# EasyEDA Pro project 2-64 M circuit board.eprj

# Schematic FUJICA AX-5
Board Name: FUJICA AX-5; Create Date: 2026-02-07; Page Name: 2-64 M circuit board; Project Name: FUJICA AX-5; Schematic Name: FUJICA AX-5; Update Date: 2026-02-09; Company: EasyEDA.com; Page Size: A4; Version: V1.0
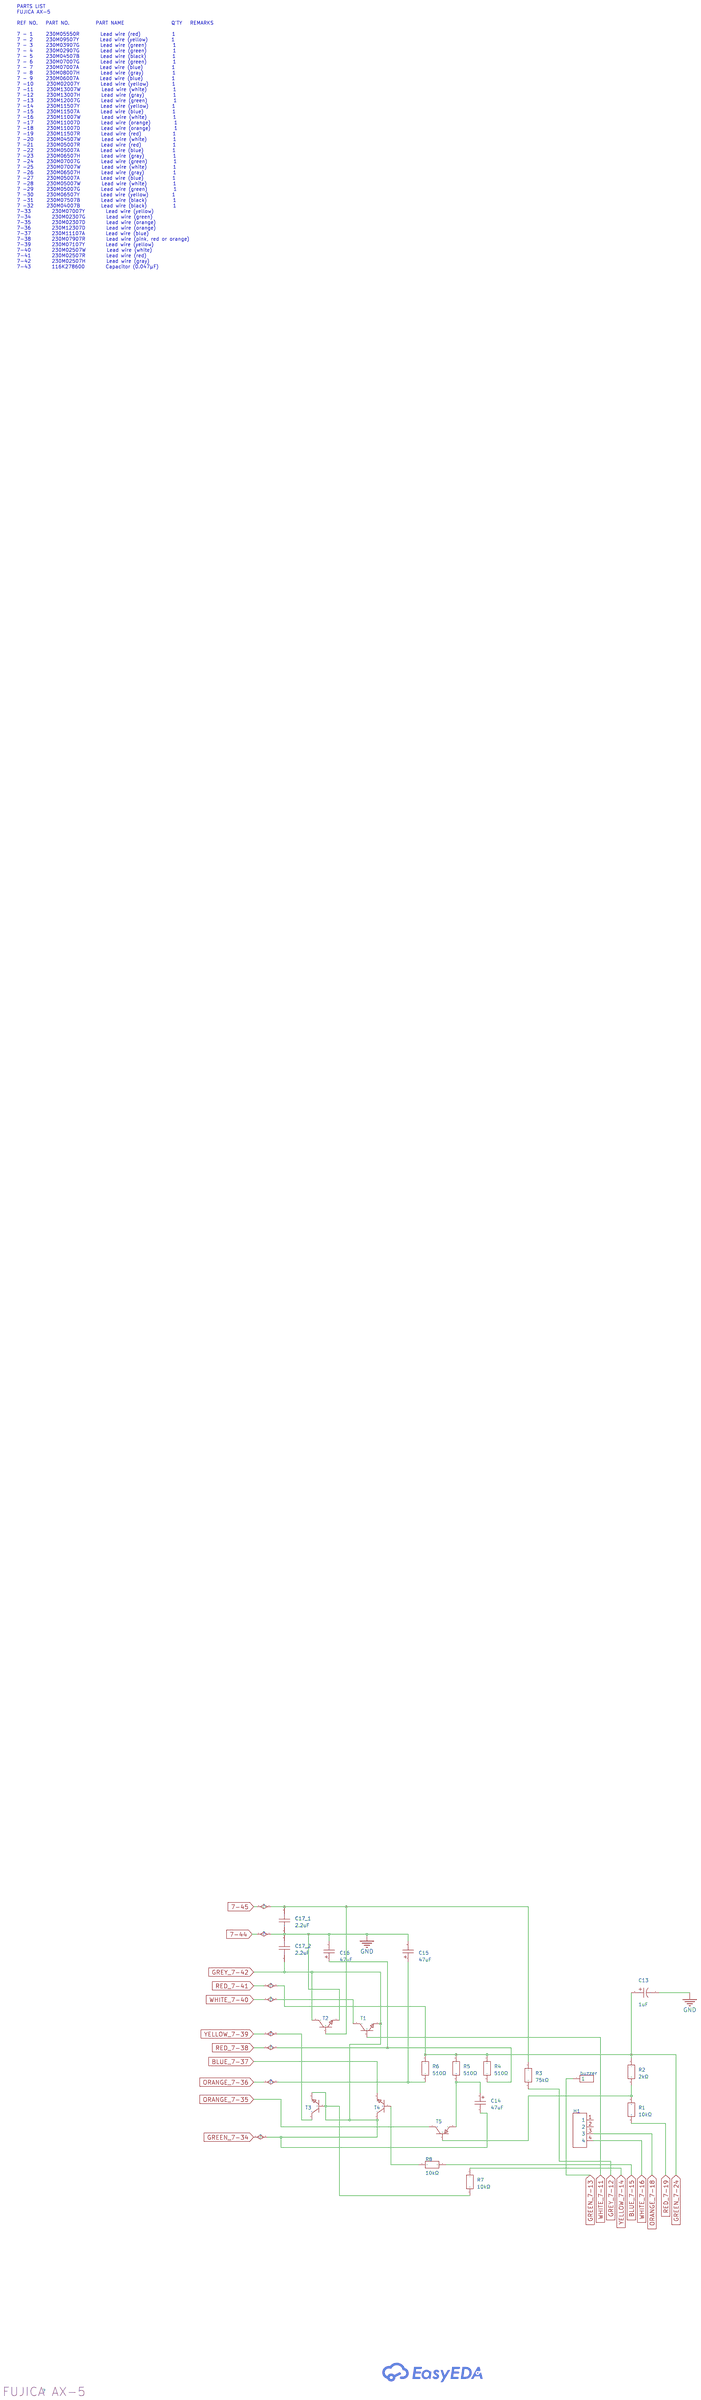
[diagram p0: schematic sheet]

## Parts
buzzer  -  [HDR-TH_1P-V-M_XKB_X4611WV-01I-C28D40]
C13  1uF  [CAP-TH_BD4.5-P2.50-D1.0-FD]
C14  47uF  [CAP-TH_BD5.0-P2.5-D0.5-FD]
C15  47uF  [CAP-TH_BD5.0-P2.5-D0.5-FD]
C16  47uF  [CAP-TH_BD5.0-P2.5-D0.5-FD]
C17_1  2.2uF  [CAP-TH_BD4.5-P2.50-D1.0-FD]
C17_2  2.2uF  [CAP-TH_BD4.5-P2.50-D1.0-FD]
H1  -  [HDR-TH_4P-P2.54-V-M]
R1  510Ω  [RES-TH_BD1.9-L3.3-P7.30-D0.5]
R2  510Ω  [RES-TH_BD1.9-L3.3-P7.30-D0.5]
R3  510Ω  [RES-TH_BD1.9-L3.3-P7.30-D0.5]
R4  510Ω  [RES-TH_BD1.9-L3.3-P7.30-D0.5]
R5  510Ω  [RES-TH_BD1.9-L3.3-P7.30-D0.5]
R6  510Ω  [RES-TH_BD1.9-L3.3-P7.30-D0.5]
R7  510Ω  [RES-TH_BD1.9-L3.3-P7.30-D0.5]
R8  510Ω  [RES-TH_BD1.9-L3.3-P7.30-D0.5]
T1  NPN-sot-23  [SOT-23-3_L2.9-W1.3-P0.95-LS2.4-BR]
T2  NPN-sot-23  [SOT-23-3_L2.9-W1.3-P0.95-LS2.4-BR]
T3  NPN-sot-23  [SOT-23-3_L2.9-W1.3-P0.95-LS2.4-BR]
T4  NPN-sot-23  [SOT-23-3_L2.9-W1.3-P0.95-LS2.4-BR]
T5  PNP-sot-23  [SOT-23-3_L2.9-W1.3-P1.90-LS2.4-BR]

## Library data of the parts
buzzer = HDR-M_2.54_1x1P: Supplier Footprint: Through
C13 = TAP105K035SCS: Capacitance:1uF Tolerance:±10% Tolerance:±10% Voltage Rating:35V Equivalent Series Resistance(ESR):8Ω@100kHz Operating Temperature:-55℃~+125℃ Operating Temperature:-55℃~+125℃; LCSC Part Name: 1uF ±10% 35V; Supplier Part: C2987014; Manufacturer: Kyocera AVX; Supplier Footprint: 插件,P=2.5mm; JLCPCB Part Class: Extended Part; Supplier: LCSC; Tolerance: ±10%; Voltage Rating: 35V; Equivalent Series Resistance(ESR): 8Ω@100kHz; Operating Temperature: -55℃~+125℃
C14-C16 = TAP476K016SCS: Capacitance: Tolerance:±10% Tolerance:±10% Rated Voltage: Equivalent Series Resistance(ESR):1.3Ω@100kHz Operating Temperature:-55℃~+125℃ Operating Temperature:-55℃~+125℃; LCSC Part Name: 47uF ±10% 16V; Supplier Part: C56699; Manufacturer: Kyocera AVX; Supplier Footprint: 插件,P=2.5mm; JLCPCB Part Class: Extended Part; Datasheet: https://atta.szlcsc.com/upload/public/pdf/source/20191107/C444779_CCD9EA7F36AC07ADEC9ACFBB03523055.pdf; Supplier: LCSC; Tolerance: ±10%; Equivalent Series Resistance(ESR): 1.3Ω@100kHz; Operating Temperature: -55℃~+125℃
C17_1 C17_2 = TAP225K035SCS: Capacitance: Tolerance:±10% Tolerance:±10% Rated Voltage: Equivalent Series Resistance(ESR):5Ω@100kHz Operating Temperature:-55℃~+125℃ Operating Temperature:-55℃~+125℃; LCSC Part Name: 2.2uF ±10% 35V; Supplier Part: C50520; Manufacturer: Kyocera AVX; Supplier Footprint: 插件,P=5mm; JLCPCB Part Class: Extended Part; Datasheet: https://atta.szlcsc.com/upload/public/pdf/source/20191107/C444779_CCD9EA7F36AC07ADEC9ACFBB03523055.pdf; Supplier: LCSC; Tolerance: ±10%; Equivalent Series Resistance(ESR): 5Ω@100kHz; Operating Temperature: -55℃~+125℃
H1 = HDR-M_2.54_1x4P: Supplier Footprint: Through
R1-R8 = MF0S4FF5100A50: Type:Metal Film Resistors Resistance:510Ω Tolerance:±1% Tolerance:±1% Power(Watts):250mW; LCSC Part Name: 金属膜电阻 510Ω ±1% 250mW 温漂：±50PPM; Supplier Part: C18724267; Manufacturer: UNI-ROYAL(厚声); Supplier Footprint: 插件,D1.9xL3.3mm; JLCPCB Part Class: Extended Part; Datasheet: https://atta.szlcsc.com/upload/public/pdf/source/20200826/C778422_A75C16D24F3F4B91F841C5277BB30A6A.pdf; Supplier: LCSC; Type: Metal Film Resistors; Tolerance: ±1%; Power(Watts): 250mW
T1-T4 = NPN-sot-23: Supplier Part: C9900005297; Supplier Footprint: SOT-23; JLCPCB Part Class: Extended Part; Supplier: LCSC
T5 = PNP-sot-23: Supplier Part: C9900005269; Supplier Footprint: SOT-23-3; JLCPCB Part Class: Extended Part; Supplier: LCSC

## Nets
GND: C13.1 C15.2 C16.2 C17_1.1 C17_2.2 T2.2(E)
7-45: C17_1.2 R3.1 T2.1(B)
BLUE_7-15: R8.1
BLUE_7-37: T4.2(E)
GREEN_7-13: buzzer.1
GREEN_7-24: C13.2 R2.1 R4.1 R5.1 R6.1
GREEN_7-34: C14.2 C17_2.1 R7.2 T1.2(E) T2.3(C) T3.1(B) T3.2(E) T4.3(C)
GREY_7-12: R3.2
ORANGE_7-18: H1.3
ORANGE_7-35: T5.3(C)
ORANGE_7-36: C15.1 R6.2
RED_7-19: R1.2
RED_7-38: C16.1 R4.2
WHITE_7-11: T1.1(B)
WHITE_7-16: H1.4
WHITE_7-40: T1.3(C)
YELLOW_7-14: R7.1
YELLOW_7-39: T3.3(C)
Net-(C14-1): C14.1 R5.2 T5.2(E)
Net-(R1-1): R1.1 R2.2 T5.1(B)
Net-(R8-2): R8.2 T4.1(B)

Not connected (* = marked no-connect by the designer): H1 1 2

## Notes on the sheet
- PARTS LIST
  FUJICA AX-5
  REF NO.   PART NO.          PART NAME                  Q'TY   REMARKS
  7 - 1     230M05550R        Lead wire (red)            1
  7 - 2     230M09507Y        Lead wire (yellow)         1
  7 - 3     230M03907G        Lead wire (green)          1
  7 - 4     230M02907G        Lead wire (green)          1
  7 - 5     230M04507B        Lead wire (black)          1
  7 - 6     230M07007G        Lead wire (green)          1
  7 - 7     230M07007A        Lead wire (blue)           1
  7 - 8     230M08007H        Lead wire (gray)           1
  7 - 9     230M06007A        Lead wire (blue)           1
  7 -10     230M02007Y        Lead wire (yellow)         1
  7 -11     230M13007W        Lead wire (white)          1
  7 -12     230M13007H        Lead wire (gray)           1
  7 -13     230M12007G        Lead wire (green)          1
  7 -14     230M11507Y        Lead wire (yellow)         1
  7 -15     230M11507A        Lead wire (blue)           1
  7 -16     230M11007W        Lead wire (white)          1
  7 -17     230M11007D        Lead wire (orange)         1
  7 -18     230M11007D        Lead wire (orange)         1
  7 -19     230M11507R        Lead wire (red)            1
  7 -20     230M04507W        Lead wire (white)          1
  7 -21     230M05007R        Lead wire (red)            1
  7 -22     230M05007A        Lead wire (blue)           1
  7 -23     230M06507H        Lead wire (gray)           1
  7 -24     230M07007G        Lead wire (green)          1
  7 -25     230M07007W        Lead wire (white)          1
  7 -26     230M06507H        Lead wire (gray)           1
  7 -27     230M05007A        Lead wire (blue)           1
  7 -28     230M05007W        Lead wire (white)          1
  7 -29     230M05007G        Lead wire (green)          1
  7 -30     230M06507Y        Lead wire (yellow)         1
  7 -31     230M07507B        Lead wire (black)          1
  7 -32     230M04007B        Lead wire (black)          1
  7-33        230M07007Y        Lead wire (yellow)
  7-34        230M02307G        Lead wire (green)
  7-35        230M02307D        Lead wire (orange)
  7-36        230M12307D        Lead wire (orange)
  7-37        230M11107A        Lead wire (blue)
  7-38        230M07907R        Lead wire (pink, red or orange)
  7-39        230M07107Y        Lead wire (yellow)
  7-40        230M02507W        Lead wire (white)
  7-41        230M02507R        Lead wire (red)
  7-42        230M02507H        Lead wire (gray)
  7-43        116K278600        Capacitor (0.047μF)
